# Altium schematic sheet FPGA_Banks_RTM_IO_MISC.SchDoc
size 420 x 297 mm
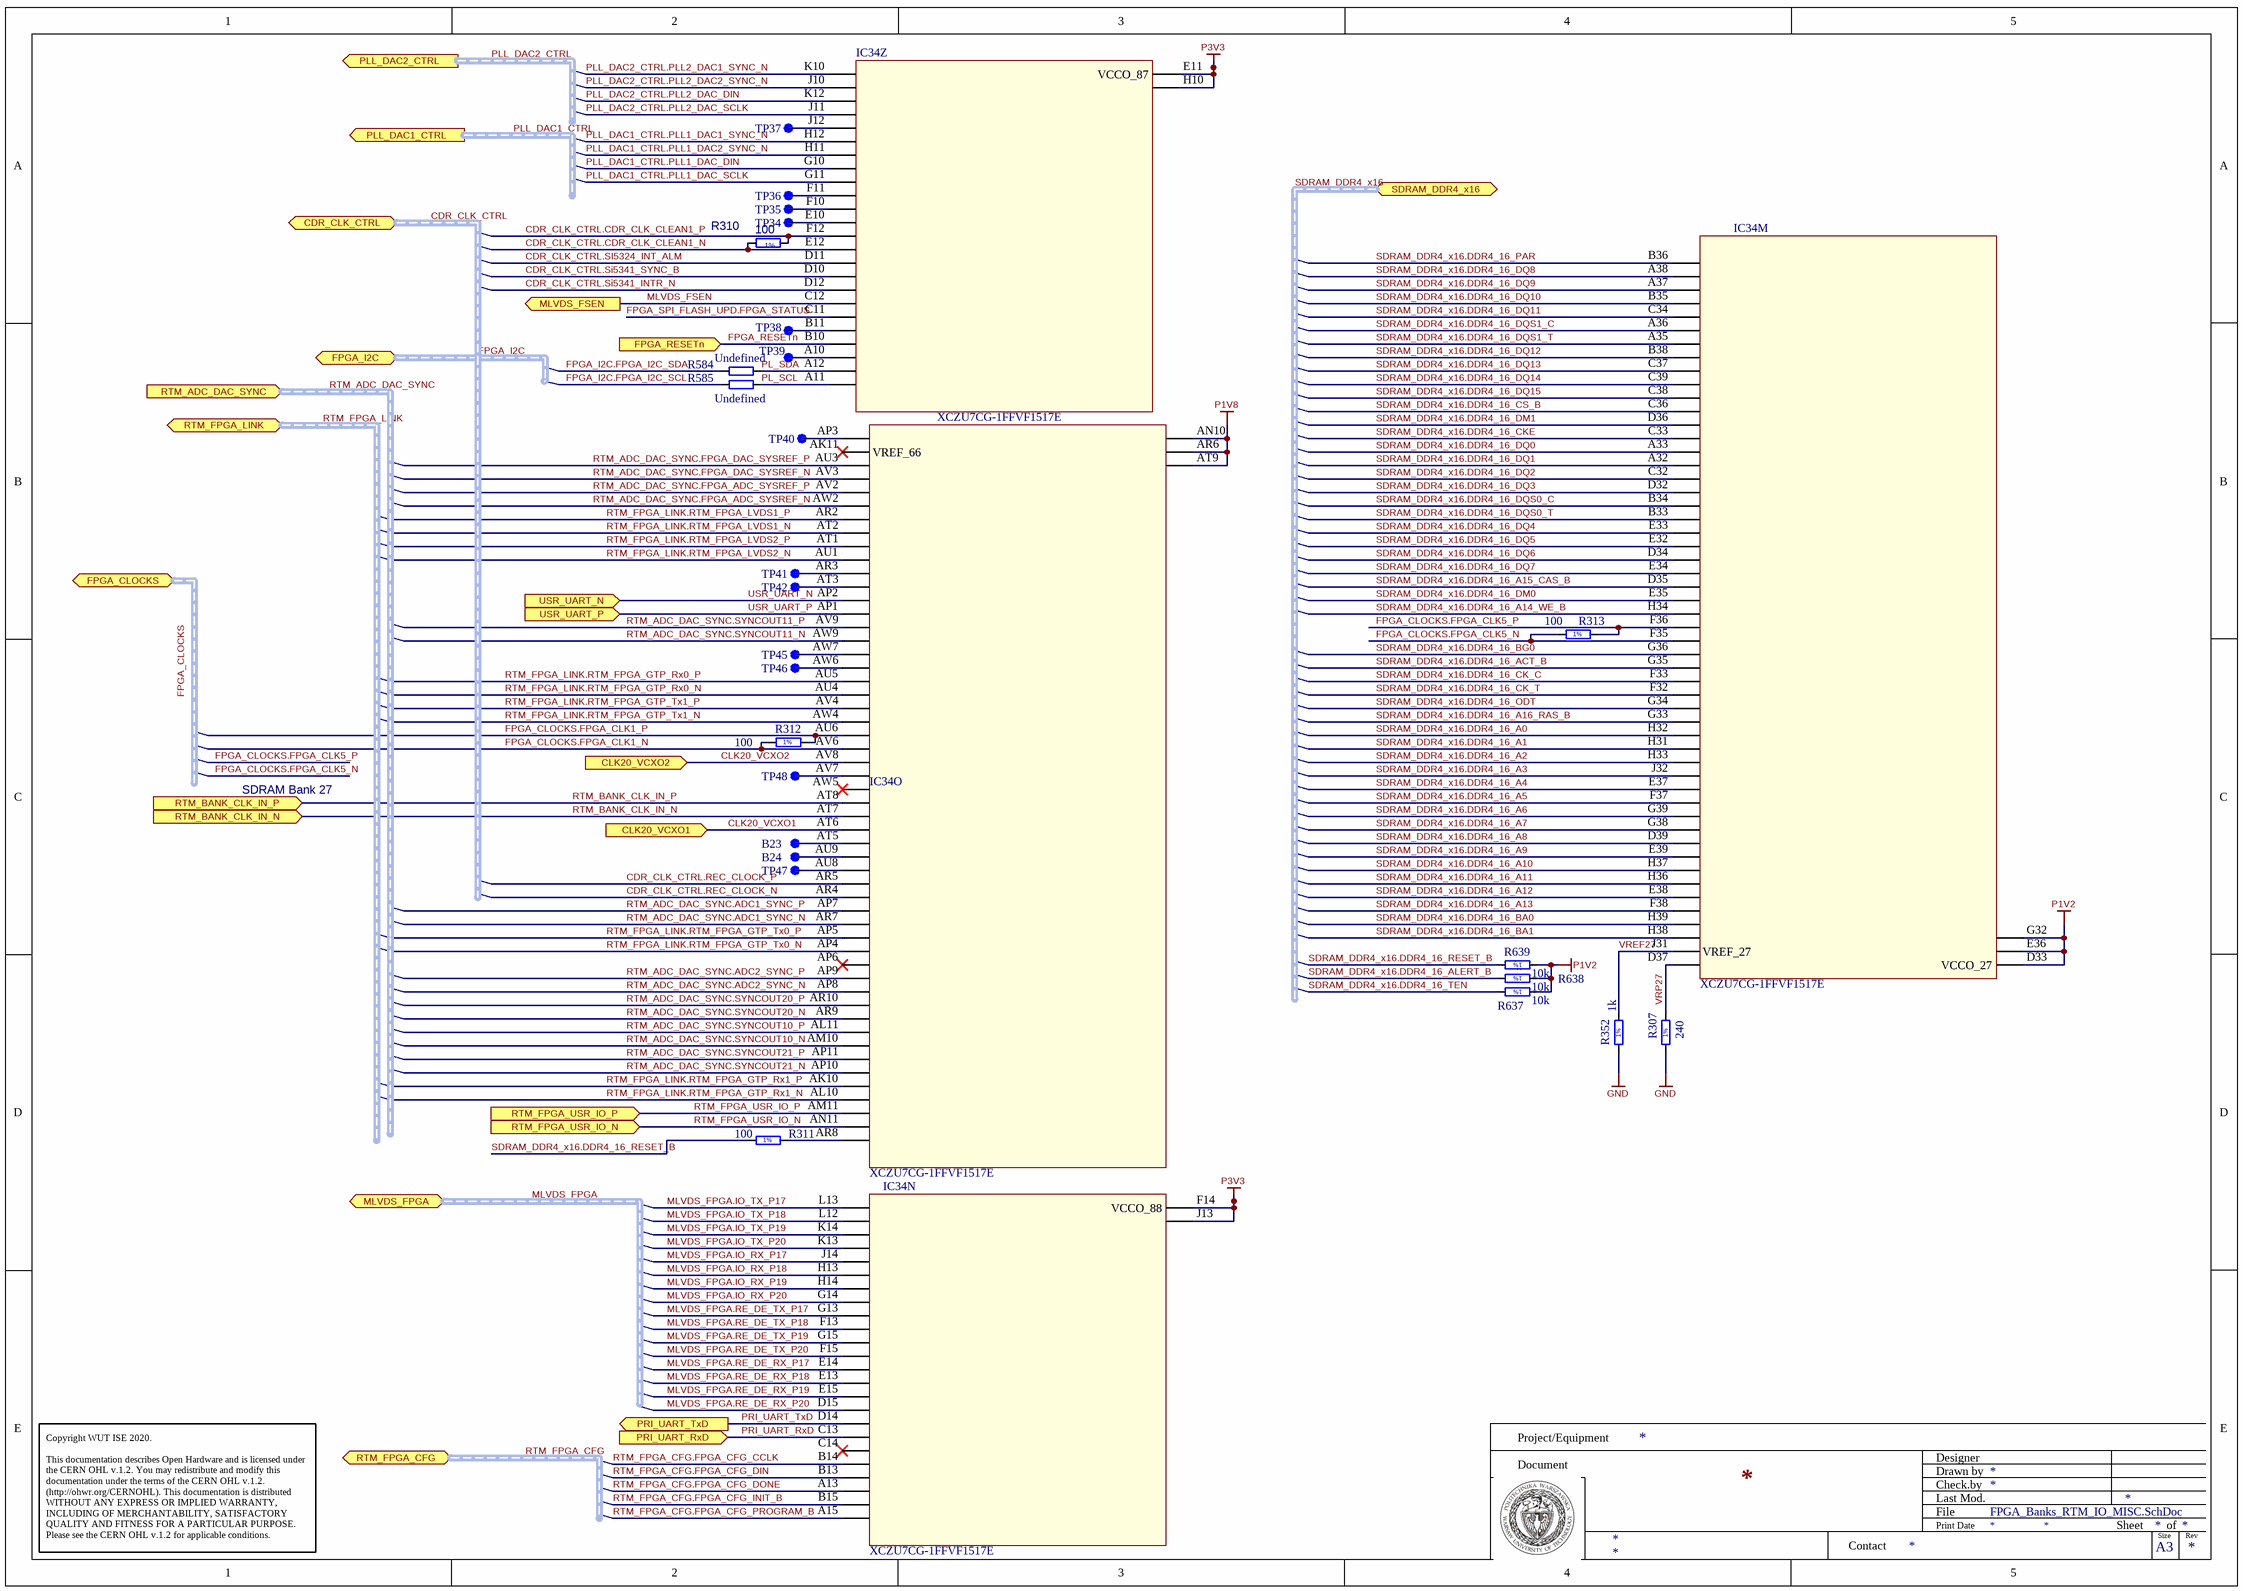
[diagram p0: FPGA_Banks_RTM_IO_MISC.SchDoc]

## Parts
B23  SMD Pad  [C100]  (value not drawn)
B24  SMD Pad  [C100]  (value not drawn)
IC34  XCZU7CG-1FFVF1517E  (parts M,N,O,Z of 26)
R307  240  [RESC1005X40N]
R310  value 100  (hidden comment: Resistor - 1% RESC1005X40N)
R311  100  [RESC1005X40N]
R312  100  [RESC1005X40N]
R313  100  [RESC1005X40N]
R352  1k  [RESC1005X40N]
R584  Undefined  [RESC1005X40N]
R585  Undefined  [RESC1005X40N]
R637  10k  [RESC1005X40N]
R638  10k  [RESC1005X40N]
R639  10k  [RESC1005X40N]
TP34  SMD Pad  [C100]  (value not drawn)
TP35  SMD Pad  [C100]  (value not drawn)
TP36  SMD Pad  [C100]  (value not drawn)
TP37  SMD Pad  [C100]  (value not drawn)
TP38  SMD Pad  [C100]  (value not drawn)
TP39  SMD Pad  [C100]  (value not drawn)
TP40  SMD Pad  [C100]  (value not drawn)
TP41  SMD Pad  [C100]  (value not drawn)
TP42  SMD Pad  [C100]  (value not drawn)
TP45  SMD Pad  [C100]  (value not drawn)
TP46  SMD Pad  [C100]  (value not drawn)
TP47  SMD Pad  [C100]  (value not drawn)
TP48  SMD Pad  [C100]  (value not drawn)

## Ports
CDR_CLK_CTRL (bidir, harness CDR_CLK_CTRL), CLK20_VCXO1 (in), CLK20_VCXO2 (in), FPGA_CLOCKS (bidir, harness FPGA_CLOCKS), FPGA_I2C (bidir, harness FPGA_I2C), FPGA_RESETn (in), MLVDS_FPGA (bidir, harness MLVDS_FPGA), MLVDS_FSEN (out), PLL_DAC1_CTRL (out, harness PLL_DAC1_CTRL), PLL_DAC2_CTRL (out, harness PLL_DAC2_CTRL), PRI_UART_RxD (in), PRI_UART_TxD (out), RTM_ADC_DAC_SYNC (in, harness RTM_ADC_DAC_SYNC), RTM_BANK_CLK_IN_N (in), RTM_BANK_CLK_IN_P (in), RTM_FPGA_CFG (bidir, harness RTM_FPGA_CFG), RTM_FPGA_LINK (bidir, harness RTM_FPGA_LINK), RTM_FPGA_USR_IO_N (in), RTM_FPGA_USR_IO_P (in), SDRAM_DDR4_x16 (bidir, harness SDRAM_DDR4_x16), USR_UART_N (in), USR_UART_P (in)

## Nets
GND: R307.1 R352.1
P1V2: IC34.D33(VCCO_27) IC34.E36(VCCO_27_1) IC34.G32(VCCO_27_2) R637.1 R638.1 R639.1
P1V8: IC34.AN10(VCCO_66) IC34.AR6(VCCO_66_1) IC34.AT9(VCCO_66_2)
P3V3: IC34.E11(VCCO_87) IC34.F14(VCCO_88) IC34.H10(VCCO_87_1) IC34.J13(VCCO_88_1)
CDR_CLK_CTRL.CDR_CLK_CLEAN1_N: IC34.E12(IOB_X3Y235) R310.1
CDR_CLK_CTRL.CDR_CLK_CLEAN1_P: IC34.F12(IOB_X3Y234) R310.2
CDR_CLK_CTRL.REC_CLOCK_N: IC34.AR4(IOB_X2Y189)
CDR_CLK_CTRL.REC_CLOCK_P: IC34.AR5(IOB_X2Y188)
CDR_CLK_CTRL.SI5324_INT_ALM: IC34.D11(IOB_X3Y236)
CDR_CLK_CTRL.Si5341_INTR_N: IC34.D12(IOB_X3Y238)
CDR_CLK_CTRL.Si5341_SYNC_B: IC34.D10(IOB_X3Y237)
CLK20_VCXO1: IC34.AT6(IOB_X2Y184) ; port CLK20_VCXO1
CLK20_VCXO2: IC34.AV8(IOB_X2Y179) ; port CLK20_VCXO2
FPGA_CLOCKS.FPGA_CLK1_N: IC34.AV6(IOB_X2Y178) R312.1
FPGA_CLOCKS.FPGA_CLK1_P: IC34.AU6(IOB_X2Y177) R312.2
FPGA_CLOCKS.FPGA_CLK5_N: IC34.F35(IOB_X0Y231) R313.1
FPGA_CLOCKS.FPGA_CLK5_P: IC34.F36(IOB_X0Y232) R313.2
FPGA_I2C.FPGA_I2C_SCL: R585.1
FPGA_I2C.FPGA_I2C_SDA: R584.1
FPGA_RESETn: IC34.B10(IOB_X3Y242) ; port FPGA_RESETn
FPGA_SPI_FLASH_UPD.FPGA_STATUS: IC34.C11(IOB_X3Y240)
MLVDS_FPGA.IO_RX_P17: IC34.J14(IOB_X3Y264)
MLVDS_FPGA.IO_RX_P18: IC34.H13(IOB_X3Y265)
MLVDS_FPGA.IO_RX_P19: IC34.H14(IOB_X3Y266)
MLVDS_FPGA.IO_RX_P20: IC34.G14(IOB_X3Y267)
MLVDS_FPGA.IO_TX_P17: IC34.L13(IOB_X3Y260)
MLVDS_FPGA.IO_TX_P18: IC34.L12(IOB_X3Y261)
MLVDS_FPGA.IO_TX_P19: IC34.K14(IOB_X3Y262)
MLVDS_FPGA.IO_TX_P20: IC34.K13(IOB_X3Y263)
MLVDS_FPGA.RE_DE_RX_P17: IC34.E14(IOB_X3Y286)
MLVDS_FPGA.RE_DE_RX_P18: IC34.E13(IOB_X3Y287)
MLVDS_FPGA.RE_DE_RX_P19: IC34.E15(IOB_X3Y288)
MLVDS_FPGA.RE_DE_RX_P20: IC34.D15(IOB_X3Y289)
MLVDS_FPGA.RE_DE_TX_P17: IC34.G13(IOB_X3Y268)
MLVDS_FPGA.RE_DE_TX_P18: IC34.F13(IOB_X3Y269)
MLVDS_FPGA.RE_DE_TX_P19: IC34.G15(IOB_X3Y270)
MLVDS_FPGA.RE_DE_TX_P20: IC34.F15(IOB_X3Y271)
MLVDS_FSEN: IC34.C12(IOB_X3Y239) ; port MLVDS_FSEN
PL_SCL: IC34.A11(IOB_X3Y245) R585.2
PL_SDA: IC34.A12(IOB_X3Y244) R584.2
PLL_DAC1_CTRL.PLL1_DAC1_SYNC_N: IC34.H12(IOB_X3Y213)
PLL_DAC1_CTRL.PLL1_DAC2_SYNC_N: IC34.H11(IOB_X3Y214)
PLL_DAC1_CTRL.PLL1_DAC_DIN: IC34.G10(IOB_X3Y215)
PLL_DAC1_CTRL.PLL1_DAC_SCLK: IC34.G11(IOB_X3Y216)
PLL_DAC2_CTRL.PLL2_DAC1_SYNC_N: IC34.K10(IOB_X3Y208)
PLL_DAC2_CTRL.PLL2_DAC2_SYNC_N: IC34.J10(IOB_X3Y209)
PLL_DAC2_CTRL.PLL2_DAC_DIN: IC34.K12(IOB_X3Y210)
PLL_DAC2_CTRL.PLL2_DAC_SCLK: IC34.J11(IOB_X3Y211)
PRI_UART_RxD: IC34.C13(IOB_X3Y291) ; port PRI_UART_RxD
PRI_UART_TxD: IC34.D14(IOB_X3Y290) ; port PRI_UART_TxD
RTM_ADC_DAC_SYNC.ADC1_SYNC_N: IC34.AR7(IOB_X2Y191)
RTM_ADC_DAC_SYNC.ADC1_SYNC_P: IC34.AP7(IOB_X2Y190)
RTM_ADC_DAC_SYNC.ADC2_SYNC_N: IC34.AP8(IOB_X2Y196)
RTM_ADC_DAC_SYNC.ADC2_SYNC_P: IC34.AP9(IOB_X2Y195)
RTM_ADC_DAC_SYNC.FPGA_ADC_SYSREF_N: IC34.AW2(IOB_X2Y159)
RTM_ADC_DAC_SYNC.FPGA_ADC_SYSREF_P: IC34.AV2(IOB_X2Y158)
RTM_ADC_DAC_SYNC.FPGA_DAC_SYSREF_N: IC34.AV3(IOB_X2Y157)
RTM_ADC_DAC_SYNC.FPGA_DAC_SYSREF_P: IC34.AU3(IOB_X2Y156)
RTM_ADC_DAC_SYNC.SYNCOUT10_N: IC34.AM10(IOB_X2Y200)
RTM_ADC_DAC_SYNC.SYNCOUT10_P: IC34.AL11(IOB_X2Y199)
RTM_ADC_DAC_SYNC.SYNCOUT11_N: IC34.AW9(IOB_X2Y170)
RTM_ADC_DAC_SYNC.SYNCOUT11_P: IC34.AV9(IOB_X2Y169)
RTM_ADC_DAC_SYNC.SYNCOUT20_N: IC34.AR9(IOB_X2Y198)
RTM_ADC_DAC_SYNC.SYNCOUT20_P: IC34.AR10(IOB_X2Y197)
RTM_ADC_DAC_SYNC.SYNCOUT21_N: IC34.AP10(IOB_X2Y202)
RTM_ADC_DAC_SYNC.SYNCOUT21_P: IC34.AP11(IOB_X2Y201)
RTM_BANK_CLK_IN_N: IC34.AT7(IOB_X2Y183) ; port RTM_BANK_CLK_IN_N
RTM_BANK_CLK_IN_P: IC34.AT8(IOB_X2Y182) ; port RTM_BANK_CLK_IN_P
RTM_FPGA_CFG.FPGA_CFG_CCLK: IC34.B14(IOB_X3Y293)
RTM_FPGA_CFG.FPGA_CFG_DIN: IC34.B13(IOB_X3Y294)
RTM_FPGA_CFG.FPGA_CFG_DONE: IC34.A13(IOB_X3Y295)
RTM_FPGA_CFG.FPGA_CFG_INIT_B: IC34.B15(IOB_X3Y296)
RTM_FPGA_CFG.FPGA_CFG_PROGRAM_B: IC34.A15(IOB_X3Y297)
RTM_FPGA_LINK.RTM_FPGA_GTP_Rx0_N: IC34.AU4(IOB_X2Y174)
RTM_FPGA_LINK.RTM_FPGA_GTP_Rx0_P: IC34.AU5(IOB_X2Y173)
RTM_FPGA_LINK.RTM_FPGA_GTP_Rx1_N: IC34.AL10(IOB_X2Y204)
RTM_FPGA_LINK.RTM_FPGA_GTP_Rx1_P: IC34.AK10(IOB_X2Y203)
RTM_FPGA_LINK.RTM_FPGA_GTP_Tx0_N: IC34.AP4(IOB_X2Y193)
RTM_FPGA_LINK.RTM_FPGA_GTP_Tx0_P: IC34.AP5(IOB_X2Y192)
RTM_FPGA_LINK.RTM_FPGA_GTP_Tx1_N: IC34.AW4(IOB_X2Y176)
RTM_FPGA_LINK.RTM_FPGA_GTP_Tx1_P: IC34.AV4(IOB_X2Y175)
RTM_FPGA_LINK.RTM_FPGA_LVDS1_N: IC34.AT2(IOB_X2Y161)
RTM_FPGA_LINK.RTM_FPGA_LVDS1_P: IC34.AR2(IOB_X2Y160)
RTM_FPGA_LINK.RTM_FPGA_LVDS2_N: IC34.AU1(IOB_X2Y163)
RTM_FPGA_LINK.RTM_FPGA_LVDS2_P: IC34.AT1(IOB_X2Y162)
RTM_FPGA_USR_IO_N: IC34.AN11(IOB_X2Y206) ; port RTM_FPGA_USR_IO_N
RTM_FPGA_USR_IO_P: IC34.AM11(IOB_X2Y205) ; port RTM_FPGA_USR_IO_P
SDRAM_DDR4_x16.DDR4_16_A0: IC34.H32(IOB_X0Y224)
SDRAM_DDR4_x16.DDR4_16_A1: IC34.H31(IOB_X0Y223)
SDRAM_DDR4_x16.DDR4_16_A2: IC34.H33(IOB_X0Y222)
SDRAM_DDR4_x16.DDR4_16_A3: IC34.J32(IOB_X0Y221)
SDRAM_DDR4_x16.DDR4_16_A4: IC34.E37(IOB_X0Y219)
SDRAM_DDR4_x16.DDR4_16_A5: IC34.F37(IOB_X0Y218)
SDRAM_DDR4_x16.DDR4_16_A6: IC34.G39(IOB_X0Y217)
SDRAM_DDR4_x16.DDR4_16_A7: IC34.G38(IOB_X0Y216)
SDRAM_DDR4_x16.DDR4_16_A8: IC34.D39(IOB_X0Y215)
SDRAM_DDR4_x16.DDR4_16_A9: IC34.E39(IOB_X0Y214)
SDRAM_DDR4_x16.DDR4_16_A10: IC34.H37(IOB_X0Y213)
SDRAM_DDR4_x16.DDR4_16_A11: IC34.H36(IOB_X0Y212)
SDRAM_DDR4_x16.DDR4_16_A12: IC34.E38(IOB_X0Y211)
SDRAM_DDR4_x16.DDR4_16_A13: IC34.F38(IOB_X0Y210)
SDRAM_DDR4_x16.DDR4_16_A14_WE_B: IC34.H34(IOB_X0Y233)
SDRAM_DDR4_x16.DDR4_16_A15_CAS_B: IC34.D35(IOB_X0Y235)
SDRAM_DDR4_x16.DDR4_16_A16_RAS_B: IC34.G33(IOB_X0Y225)
SDRAM_DDR4_x16.DDR4_16_ACT_B: IC34.G35(IOB_X0Y229)
SDRAM_DDR4_x16.DDR4_16_ALERT_B: R638.2
SDRAM_DDR4_x16.DDR4_16_BA0: IC34.H39(IOB_X0Y209)
SDRAM_DDR4_x16.DDR4_16_BA1: IC34.H38(IOB_X0Y208)
SDRAM_DDR4_x16.DDR4_16_BG0: IC34.G36(IOB_X0Y230)
SDRAM_DDR4_x16.DDR4_16_CK_C: IC34.F33(IOB_X0Y228)
SDRAM_DDR4_x16.DDR4_16_CK_T: IC34.F32(IOB_X0Y227)
SDRAM_DDR4_x16.DDR4_16_CKE: IC34.C33(IOB_X0Y246)
SDRAM_DDR4_x16.DDR4_16_CS_B: IC34.C36(IOB_X0Y248)
SDRAM_DDR4_x16.DDR4_16_DM0: IC34.E35(IOB_X0Y234)
SDRAM_DDR4_x16.DDR4_16_DM1: IC34.D36(IOB_X0Y247)
SDRAM_DDR4_x16.DDR4_16_DQ0: IC34.A33(IOB_X0Y245)
SDRAM_DDR4_x16.DDR4_16_DQ1: IC34.A32(IOB_X0Y244)
SDRAM_DDR4_x16.DDR4_16_DQ2: IC34.C32(IOB_X0Y243)
SDRAM_DDR4_x16.DDR4_16_DQ3: IC34.D32(IOB_X0Y242)
SDRAM_DDR4_x16.DDR4_16_DQ4: IC34.E33(IOB_X0Y239)
SDRAM_DDR4_x16.DDR4_16_DQ5: IC34.E32(IOB_X0Y238)
SDRAM_DDR4_x16.DDR4_16_DQ6: IC34.D34(IOB_X0Y237)
SDRAM_DDR4_x16.DDR4_16_DQ7: IC34.E34(IOB_X0Y236)
SDRAM_DDR4_x16.DDR4_16_DQ8: IC34.A38(IOB_X0Y258)
SDRAM_DDR4_x16.DDR4_16_DQ9: IC34.A37(IOB_X0Y257)
SDRAM_DDR4_x16.DDR4_16_DQ10: IC34.B35(IOB_X0Y256)
SDRAM_DDR4_x16.DDR4_16_DQ11: IC34.C34(IOB_X0Y255)
SDRAM_DDR4_x16.DDR4_16_DQ12: IC34.B38(IOB_X0Y252)
SDRAM_DDR4_x16.DDR4_16_DQ13: IC34.C37(IOB_X0Y251)
SDRAM_DDR4_x16.DDR4_16_DQ14: IC34.C39(IOB_X0Y250)
SDRAM_DDR4_x16.DDR4_16_DQ15: IC34.C38(IOB_X0Y249)
SDRAM_DDR4_x16.DDR4_16_DQS0_C: IC34.B34(IOB_X0Y241)
SDRAM_DDR4_x16.DDR4_16_DQS0_T: IC34.B33(IOB_X0Y240)
SDRAM_DDR4_x16.DDR4_16_DQS1_C: IC34.A36(IOB_X0Y254)
SDRAM_DDR4_x16.DDR4_16_DQS1_T: IC34.A35(IOB_X0Y253)
SDRAM_DDR4_x16.DDR4_16_ODT: IC34.G34(IOB_X0Y226)
SDRAM_DDR4_x16.DDR4_16_PAR: IC34.B36(IOB_X0Y259)
SDRAM_DDR4_x16.DDR4_16_RESET_B: R311.1 R639.2
SDRAM_DDR4_x16.DDR4_16_TEN: R637.2
USR_UART_N: IC34.AP2(IOB_X2Y166) ; port USR_UART_N
USR_UART_P: IC34.AP1(IOB_X2Y167) ; port USR_UART_P
VREF27: IC34.J31(VREF_27) R352.2
VRP27: IC34.D37(IOB_X0Y220) R307.2
NetB23_1: B23.1 IC34.AT5(IOB_X2Y185)
NetB24_1: B24.1 IC34.AU9(IOB_X2Y186)
NetIC34_A10: IC34.A10(IOB_X3Y243) TP39.1
NetIC34_AP3: IC34.AP3(IOB_X2Y168) TP40.1
NetIC34_AR3: IC34.AR3(IOB_X2Y164) TP41.1
NetIC34_AR8: IC34.AR8(IOB_X2Y207) R311.2
NetIC34_AT3: IC34.AT3(IOB_X2Y165) TP42.1
NetIC34_AU8: IC34.AU8(IOB_X2Y187) TP47.1
NetIC34_AV7: IC34.AV7(IOB_X2Y180) TP48.1
NetIC34_AW6: IC34.AW6(IOB_X2Y172) TP46.1
NetIC34_AW7: IC34.AW7(IOB_X2Y171) TP45.1
NetIC34_B11: IC34.B11(IOB_X3Y241) TP38.1
NetIC34_E10: IC34.E10(IOB_X3Y219) TP34.1
NetIC34_F10: IC34.F10(IOB_X3Y218) TP35.1
NetIC34_F11: IC34.F11(IOB_X3Y217) TP36.1
NetIC34_J12: IC34.J12(IOB_X3Y212) TP37.1

Not connected (* = marked no-connect by the designer): IC34 AK11(VREF_66)* AP6(IOB_X2Y194)* AW5(IOB_X2Y181)* C14(IOB_X3Y292)*

## Buses and harness runs
harness CDR_CLK_CTRL = FPGA_I2C = port CDR_CLK_CTRL = port FPGA_I2C
harness MLVDS_FPGA = port MLVDS_FPGA
harness PLL_DAC1_CTRL = port PLL_DAC1_CTRL
harness PLL_DAC2_CTRL = port PLL_DAC2_CTRL
harness RTM_ADC_DAC_SYNC = port RTM_ADC_DAC_SYNC
harness RTM_FPGA_CFG = port RTM_FPGA_CFG
harness RTM_FPGA_LINK = port RTM_FPGA_LINK
harness SDRAM_DDR4_x16 = port SDRAM_DDR4_x16

## Notes on the sheet
- SDRAM Bank 27
- Labels drawn without touching a wire or pin: FPGA_CLOCKS
- Project/Equipment
- Document
- Designer
- Drawn by
- Check.by
- Copyright WUT ISE 2020.
  This documentation describes Open Hardware and is licensed under the CERN OHL v.1.2. You may redistribute and modify this documentation under the terms of the CERN OHL v.1.2. (http://ohwr.org/CERNOHL). This documentation is distributed WITHOUT ANY EXPRESS OR IMPLIED WARRANTY, INCLUDING OF MERCHANTABILITY, SATISFACTORY QUALITY AND FITNESS FOR A PARTICULAR PURPOSE. Please see the CERN OHL v.1.2 for applicable conditions.
- Contact
- File
- Last Mod.
- Print Date
- Sheet
- Size
- A3
- of
- Rev
- (in symbol R310) 1%
- (in symbol R0402_1K_1%_0.0625W_100PPM) 1%
- (in symbol R0402_10K_1%_0.0625W_100PPM) 1%
- (in symbol R0402_100R_1%_0.0625W_100PPM) 1%
- (in symbol R0402_240R_1%_0.0625W_100PPM) 1%

## Library data of the parts
B23 B24 TP34-TP42 TP45-TP48 = SMD_PAD_D1MM: Through Hole Pad; Part Description: 1mm Diameter SMD Pad; Mounted: No; PackageDescription: 1mm Diameter SMD Pad; Part Number: SMD_PAD_D1MM; Component Kind: Standard (No BOM); Component Type: Standard (No BOM); Pin Count: 1; Family: SMD Pad; Socket: No; SMD: No; Sense: No; Status: None; ComponentHeight: 0mm; HelpURL: Undefined; Author: CERN DEM JLC; CreateDate: 10/10/2017; LatestRevisionDate: 10/10/2017
R307 = R0402_240R_1%_0.0625W_100PPM: Resistor - 1%; Manufacturer: GENERIC; Part Description: General Purpose Thick Film Chip Resistor; Manufacturer1 Part Number: 232270672401L; TC: ±100ppm/°C; PressFit: No; Manufacturer Part Number: R0402_240R_1%_0.0625W_100PPM; Part Number: R0402_240R_1%_0.0625W_100PPM; Tolerance: ±1%; Value: 240; Component Kind: Standard; Component Type: Standard; Pin Count: 2; Status: Not Recommended; Power: 0.0625W; Case: 0402; Mounted: Yes; Sense: No; Socket: No; SMD: Yes; Manufacturer1 Example: YAGEO PHYCOMP; Manufacturer1 ComponentHeight: 0.4mm; HelpURL: \\cern.ch\dfs\Applications\Altium\Datasheets\R0402_Phycomp_RC0402.pdf; Author: CERN DEM JLC; CreateDate: 03/12/2007; LatestRevisionDate: 17/10/2012
R310 = (no symbol name): Manufacturer Part Number: R0402_100R_1%_0.0625W_100PPM; Manufacturer: GENERIC; Part Description: General Purpose Thick Film Chip Resistor; CmpIndex: 1287; DXDB_LIBNAME: Resistors SMD; Ref Designator: R310; SymIndex: 317; Cell Name: RESC1005X40N; Part Name: Resistor - 1% RESC1005X40N; Part Number: Resistor - 1% RESC1005X40N; Tolerance: ±1%; Orientation: 0 = 0
R311-R313 = R0402_100R_1%_0.0625W_100PPM: Resistor - 1%; Manufacturer: GENERIC; Part Description: General Purpose Thick Film Chip Resistor; Manufacturer1 Part Number: 232270671001L; TC: ±100ppm/°C; PressFit: No; Manufacturer Part Number: R0402_100R_1%_0.0625W_100PPM; Part Number: R0402_100R_1%_0.0625W_100PPM; Tolerance: ±1%; Value: 100; Component Kind: Standard; Component Type: Standard; Pin Count: 2; Status: Not Recommended; Power: 0.0625W; Case: 0402; Mounted: Yes; Sense: No; Socket: No; SMD: Yes; Manufacturer1 Example: YAGEO PHYCOMP; Manufacturer1 ComponentHeight: 0.4mm; HelpURL: \\cern.ch\dfs\Applications\Altium\Datasheets\R0402_Phycomp_RC0402.pdf; Author: CERN DEM JLC; CreateDate: 03/12/2007; LatestRevisionDate: 17/10/2012
R352 = R0402_1K_1%_0.0625W_100PPM: Resistor - 1%; Manufacturer: GENERIC; Part Description: General Purpose Thick Film Chip Resistor; Manufacturer1 Part Number: 232270671002L; TC: ±100ppm/°C; PressFit: No; Manufacturer Part Number: R0402_1K_1%_0.0625W_100PPM; Part Number: R0402_1K_1%_0.0625W_100PPM; Tolerance: ±1%; Value: 1k; Component Kind: Standard; Component Type: Standard; Pin Count: 2; Status: Not Recommended; Power: 0.0625W; Case: 0402; Mounted: Yes; Sense: No; Socket: No; SMD: Yes; Manufacturer1 Example: YAGEO PHYCOMP; Manufacturer1 ComponentHeight: 0.4mm; HelpURL: \\cern.ch\dfs\Applications\Altium\Datasheets\R0402_Phycomp_RC0402.pdf; Author: CERN DEM JLC; CreateDate: 03/12/2007; LatestRevisionDate: 17/10/2012
R584 R585 = R0402_NO-VALUE: Resistor; Part Description: Reserved Footprint For a 0402 (1005) Chip Resistor; PressFit: No; Mounted: No; Manufacturer Part Number: R0402_NO-VALUE; Manufacturer: Undefined; Part Number: R0402_NO-VALUE; Value: Undefined; Component Kind: Standard; Component Type: Standard; Pin Count: 2; Status: None; Case: 0402; Sense: No; Socket: No; SMD: Yes; Manufacturer1 Example: Undefined; Manufacturer1 Part Number: Undefined; Manufacturer1 ComponentHeight: Undefined; HelpURL: Undefined; Author: CERN DEM JLC; CreateDate: 03/12/2007; LatestRevisionDate: 13/03/2008
R637-R639 = R0402_10K_1%_0.0625W_100PPM: Resistor - 1%; Manufacturer: GENERIC; Part Description: General Purpose Thick Film Chip Resistor; Manufacturer1 Part Number: 232270671003L; TC: ±100ppm/°C; PressFit: No; Manufacturer Part Number: R0402_10K_1%_0.0625W_100PPM; Part Number: R0402_10K_1%_0.0625W_100PPM; Tolerance: ±1%; Value: 10k; Component Kind: Standard; Component Type: Standard; Pin Count: 2; Status: Not Recommended; Power: 0.0625W; Case: 0402; Mounted: Yes; Sense: No; Socket: No; SMD: Yes; Manufacturer1 Example: YAGEO PHYCOMP; Manufacturer1 ComponentHeight: 0.4mm; HelpURL: \\cern.ch\dfs\Applications\Altium\Datasheets\R0402_Phycomp_RC0402.pdf; Author: CERN DEM JLC; CreateDate: 03/12/2007; LatestRevisionDate: 17/10/2012